# Altium schematic sheet BE200.SchDoc (part 1 of 2)
size A0
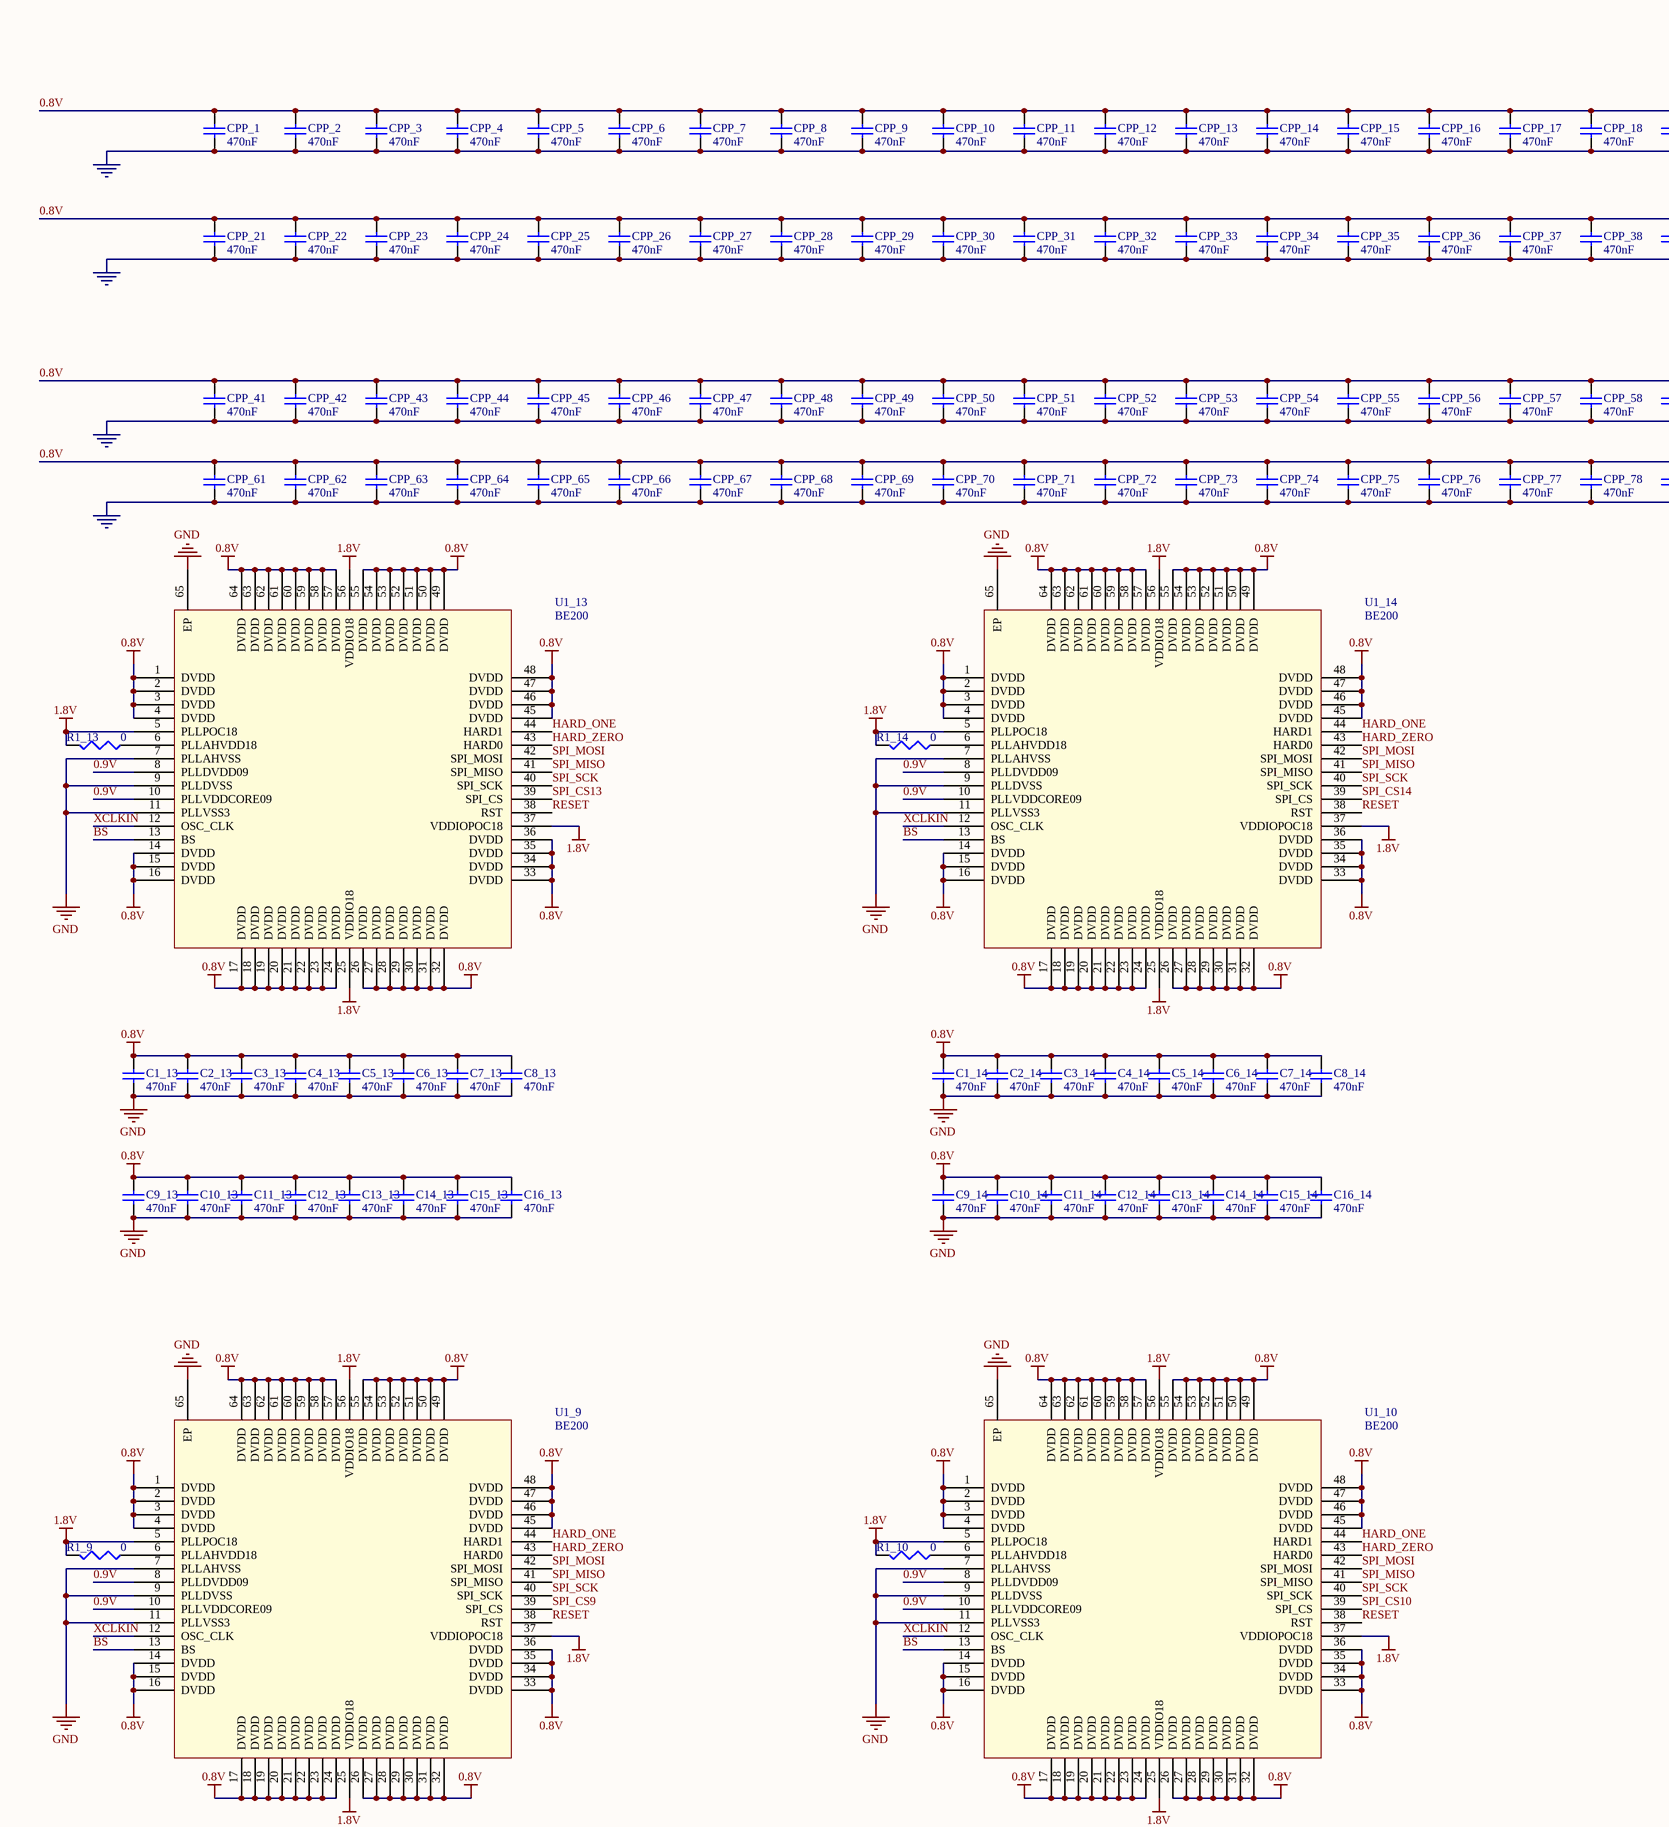
[diagram p0: BE200.SchDoc, top left]
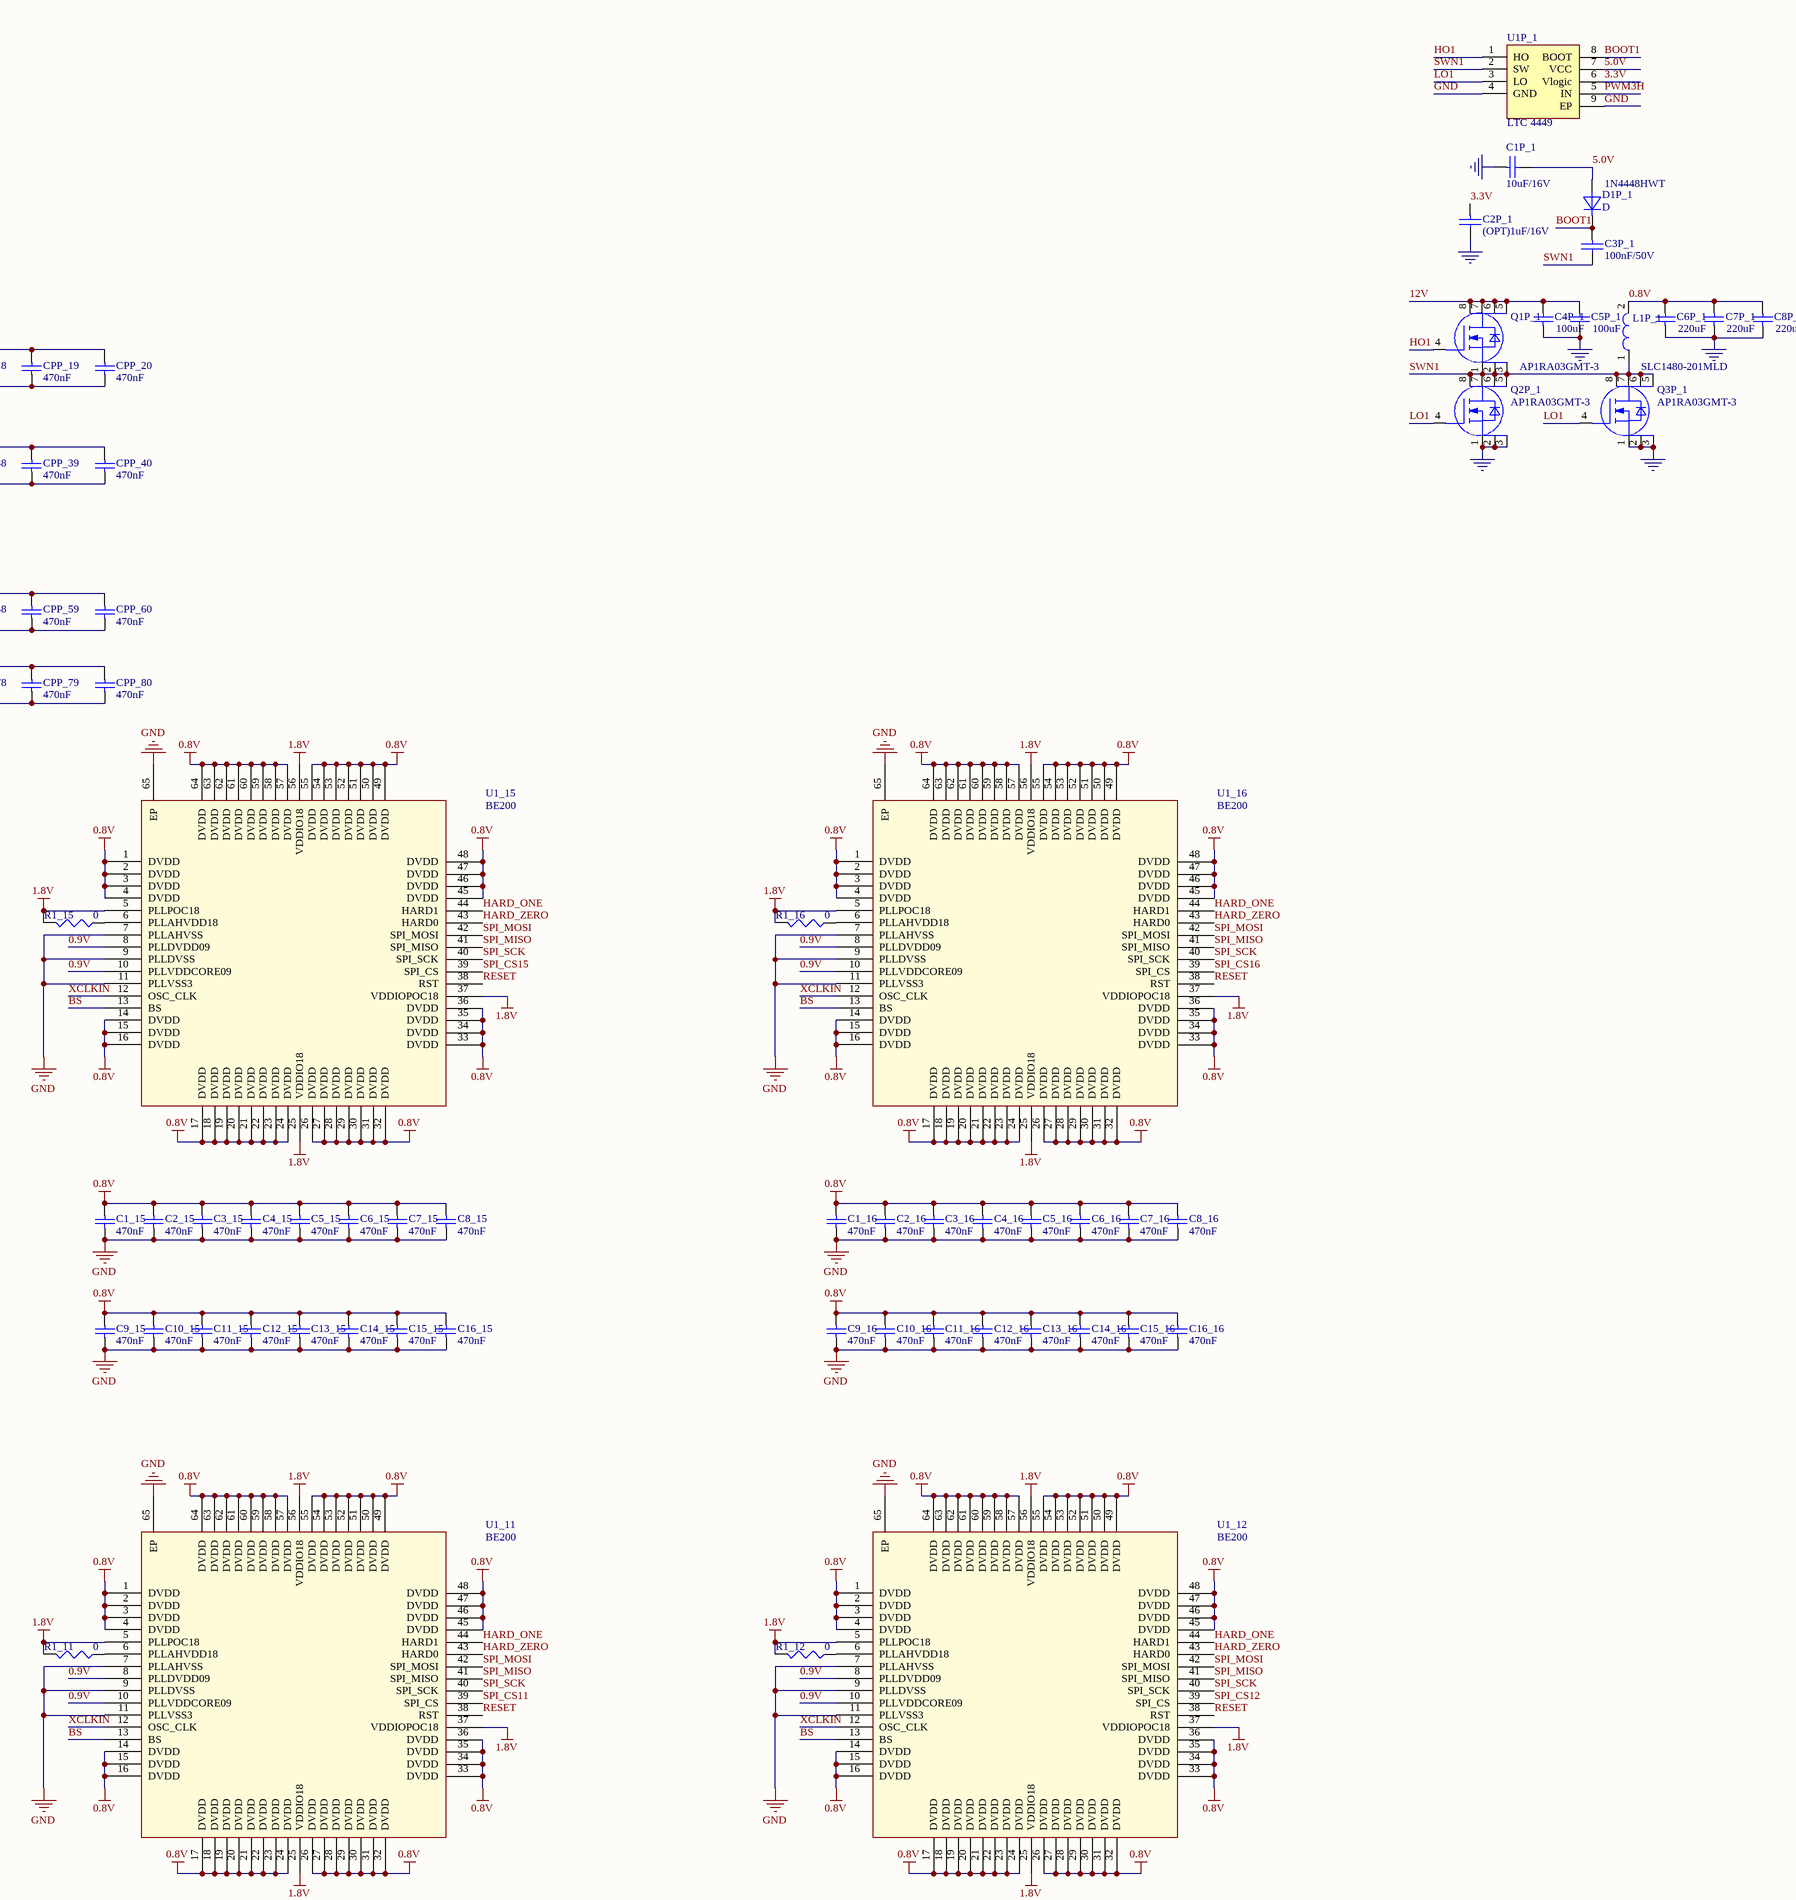
[diagram p1: BE200.SchDoc, top middle]
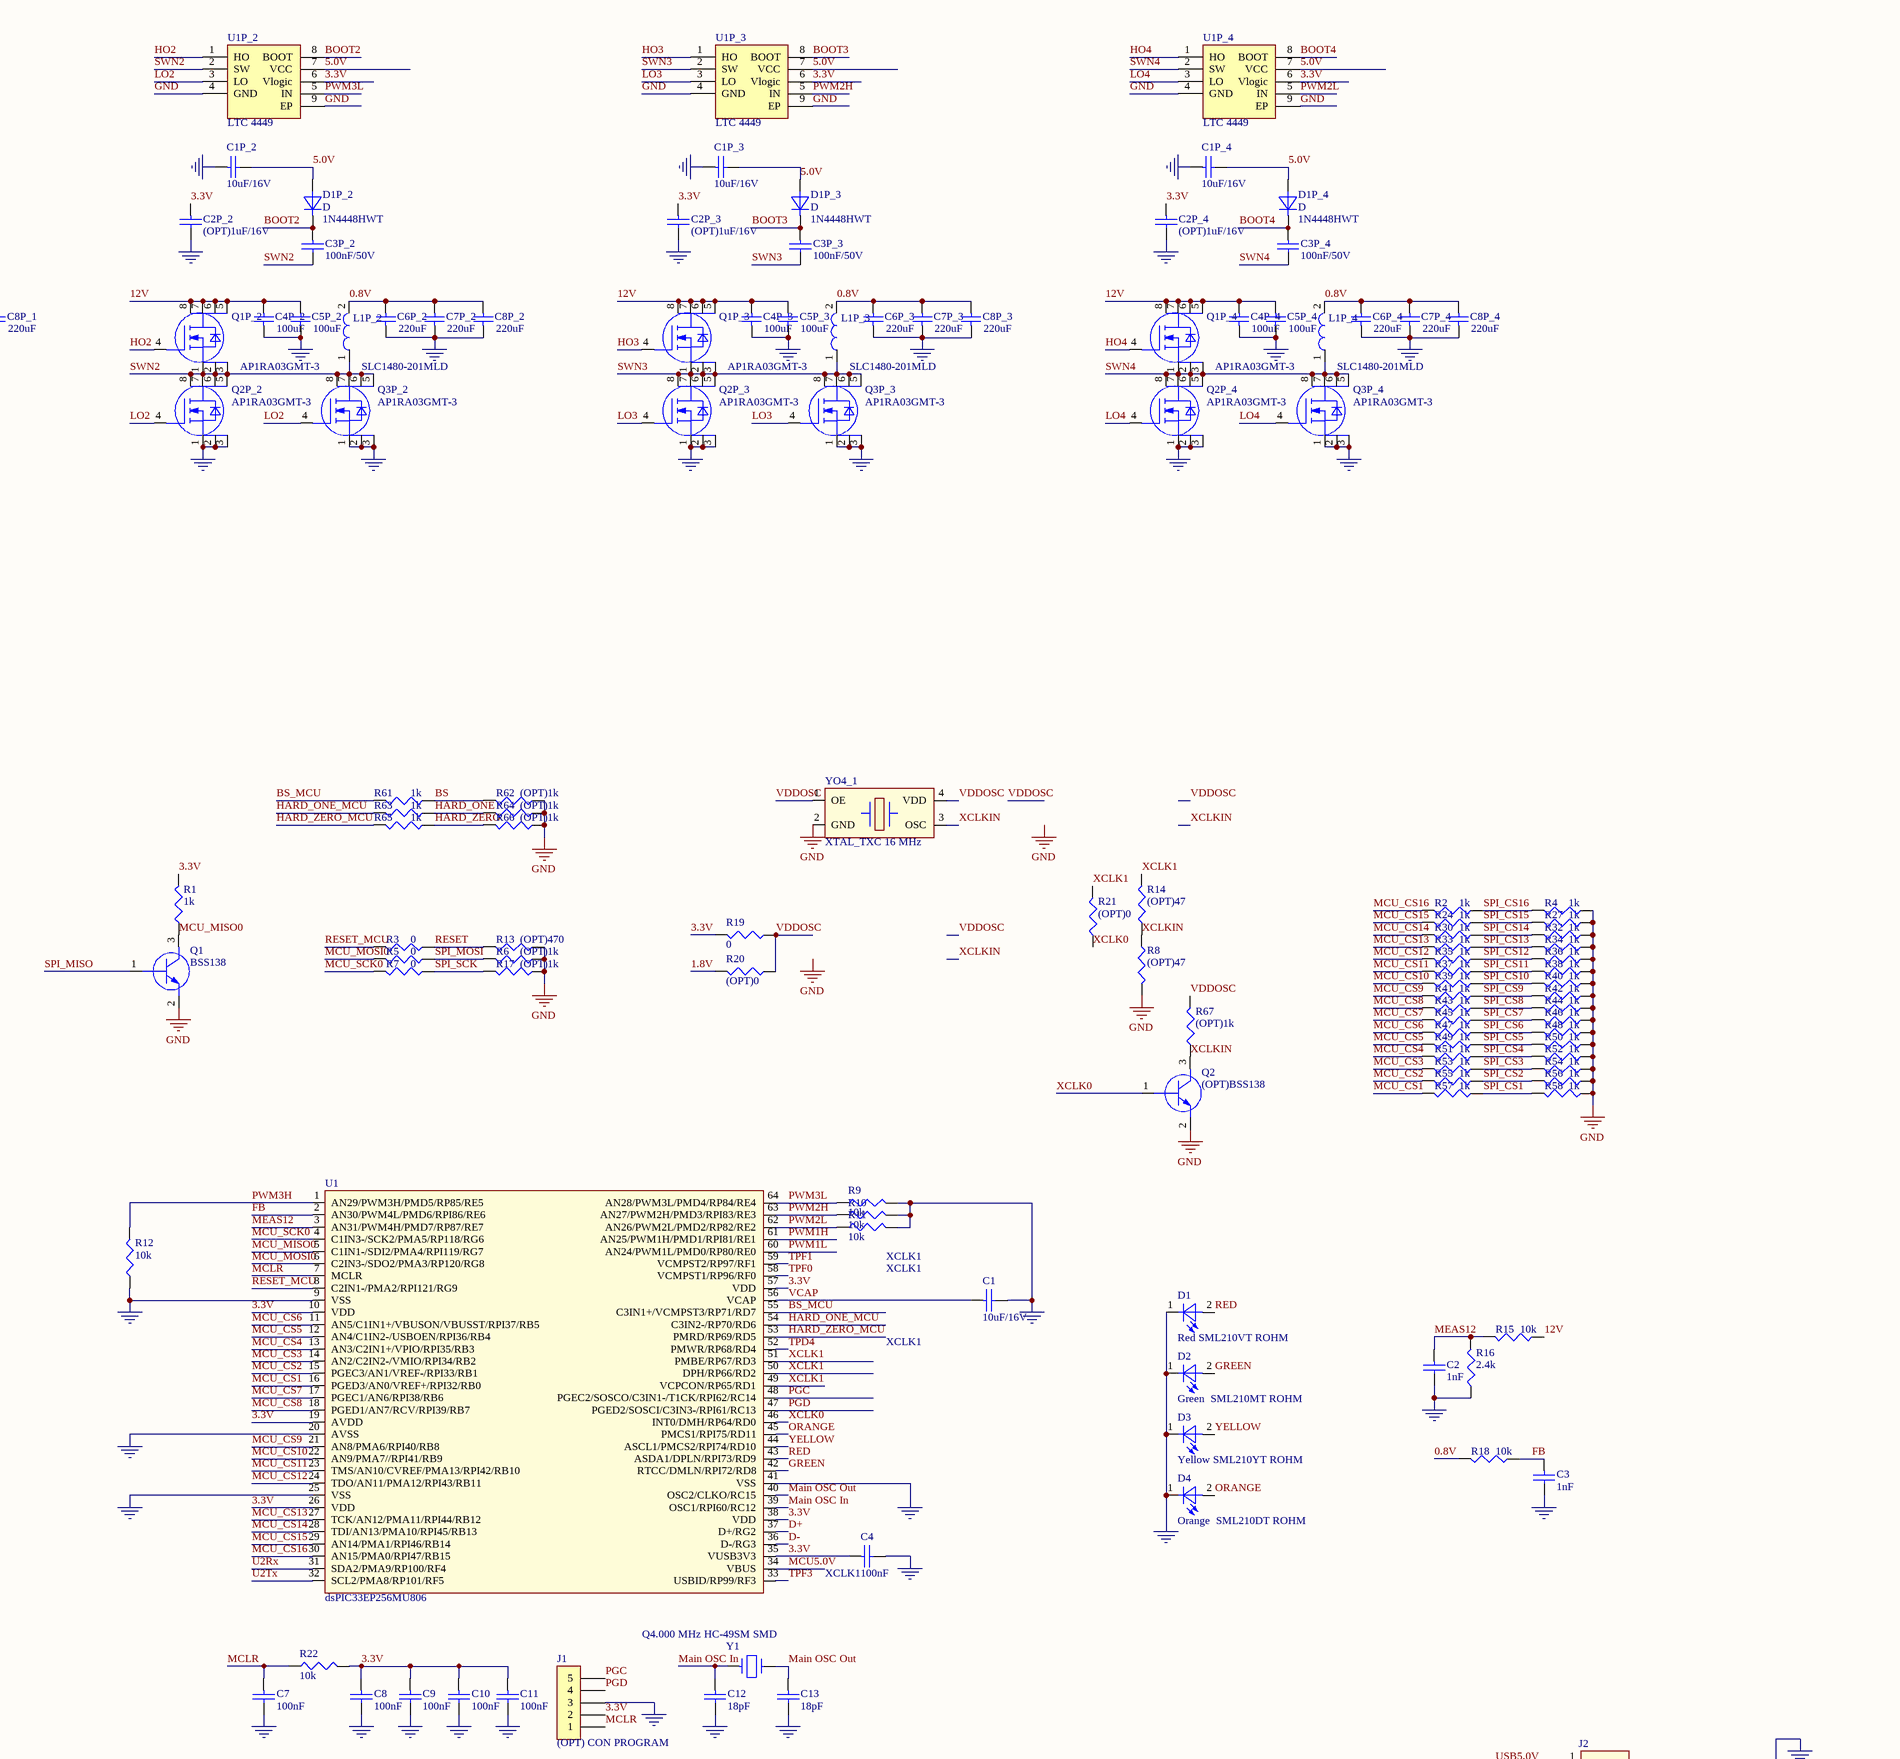
[diagram p2: BE200.SchDoc, top right]
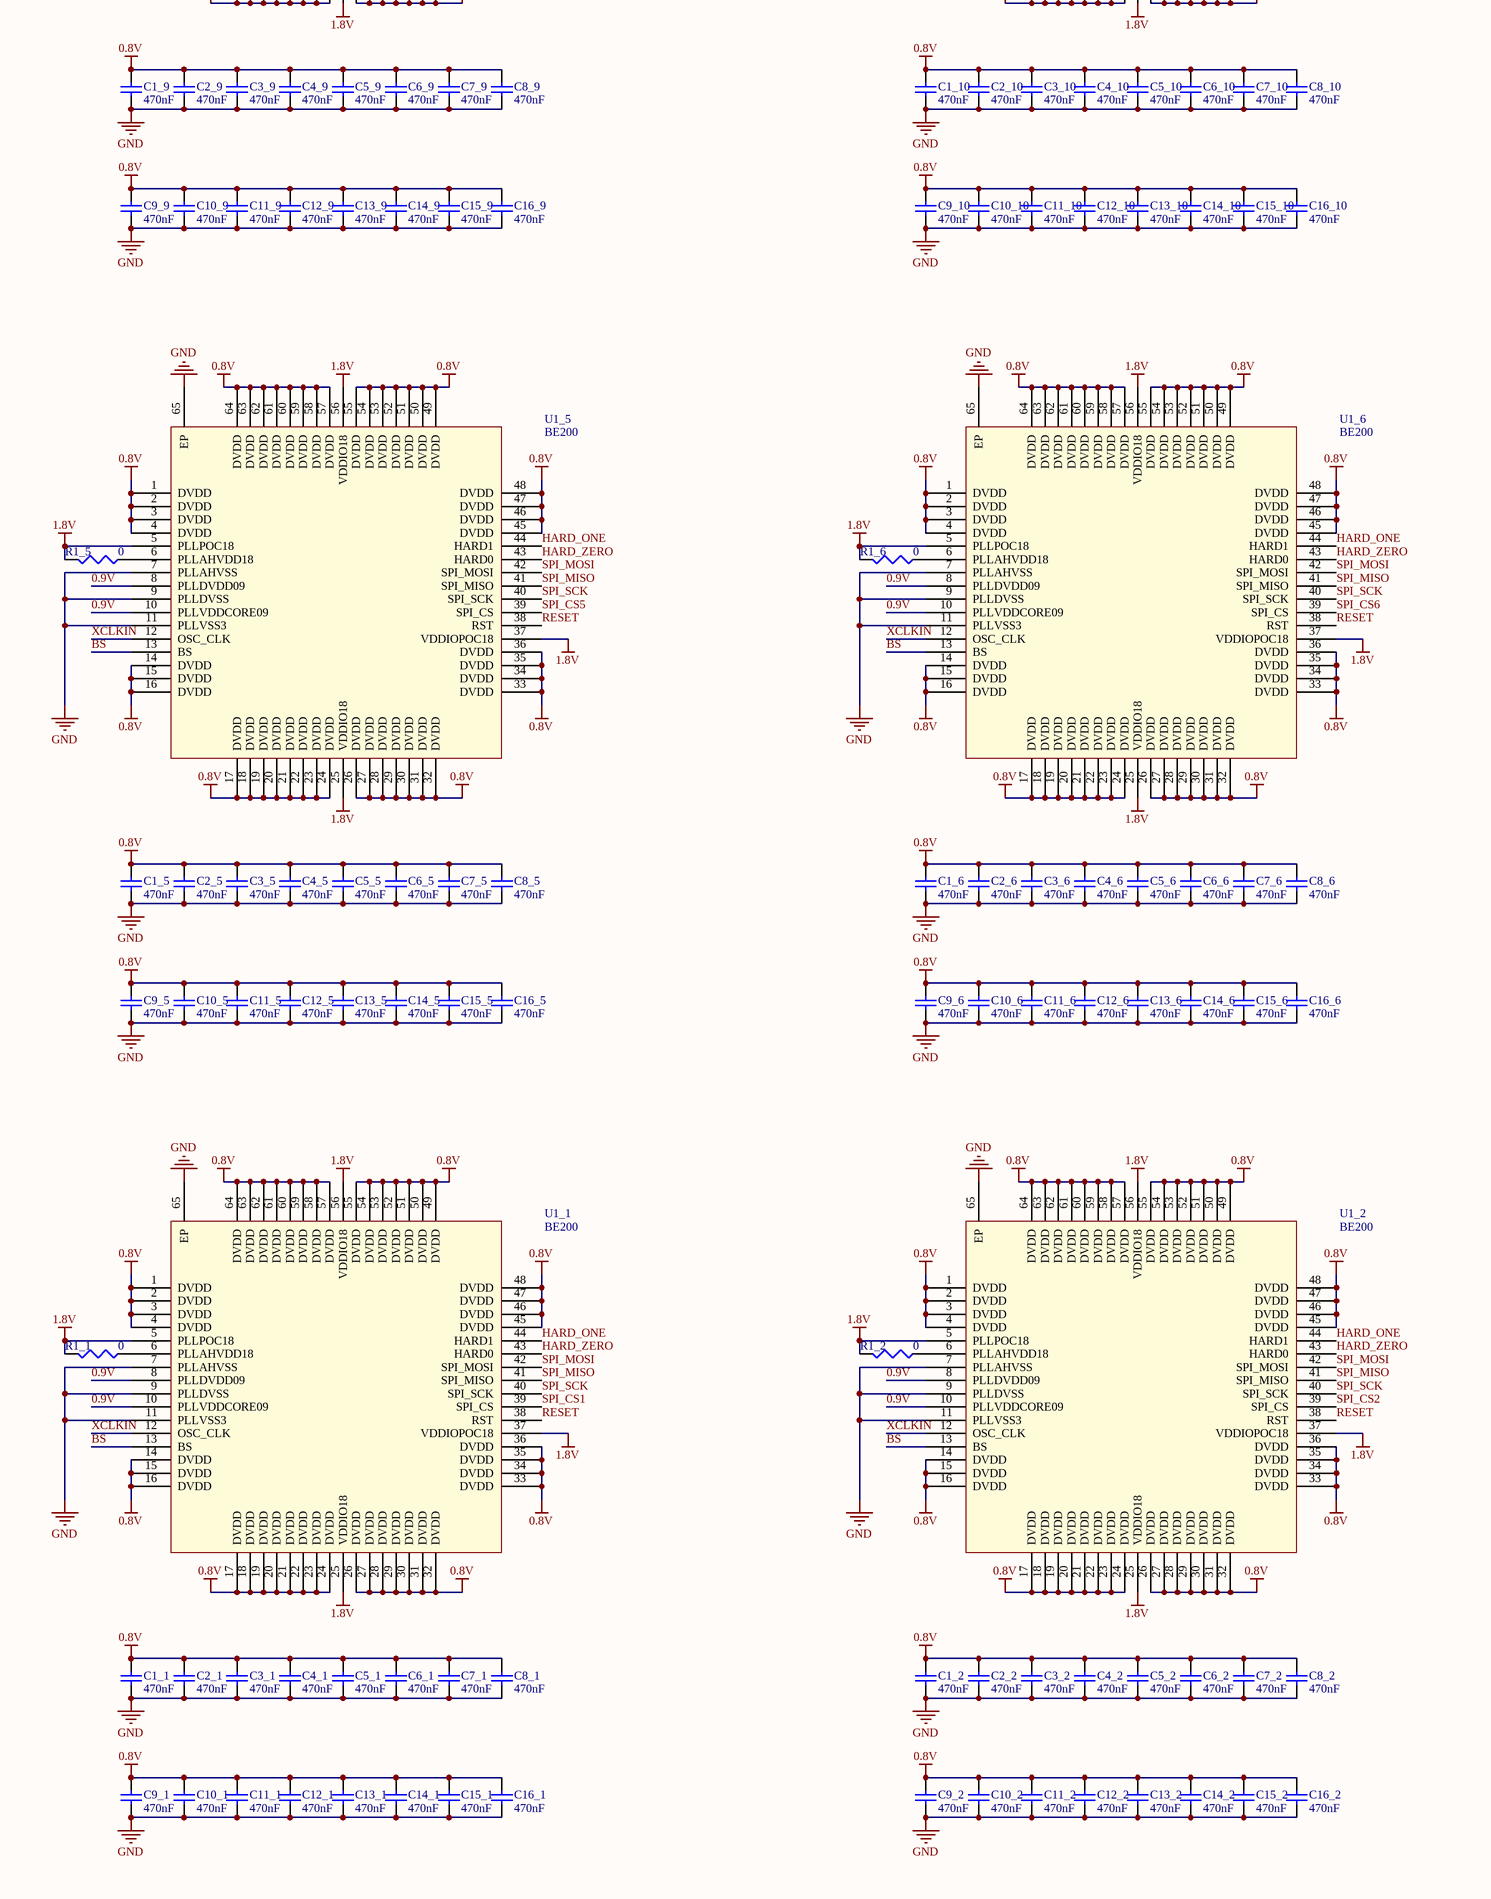
[diagram p3: BE200.SchDoc, bottom left]